# EasyEDA Pro project Cerberus_Sub_Controller_v02.eprj, schematic Cerberus_Sub_Controller_v02, sheet 1 of 3

## Sheets
1 A1: Board Name: Cerberus_Sub_Controller_v02; Create Date: 2024-08-25; Page Name: A1; Project Name: Cerberus_Sub_Controller_v02; Schematic Name: Cerberus_Sub_Controller_v02; Update Date: 2024-08-28
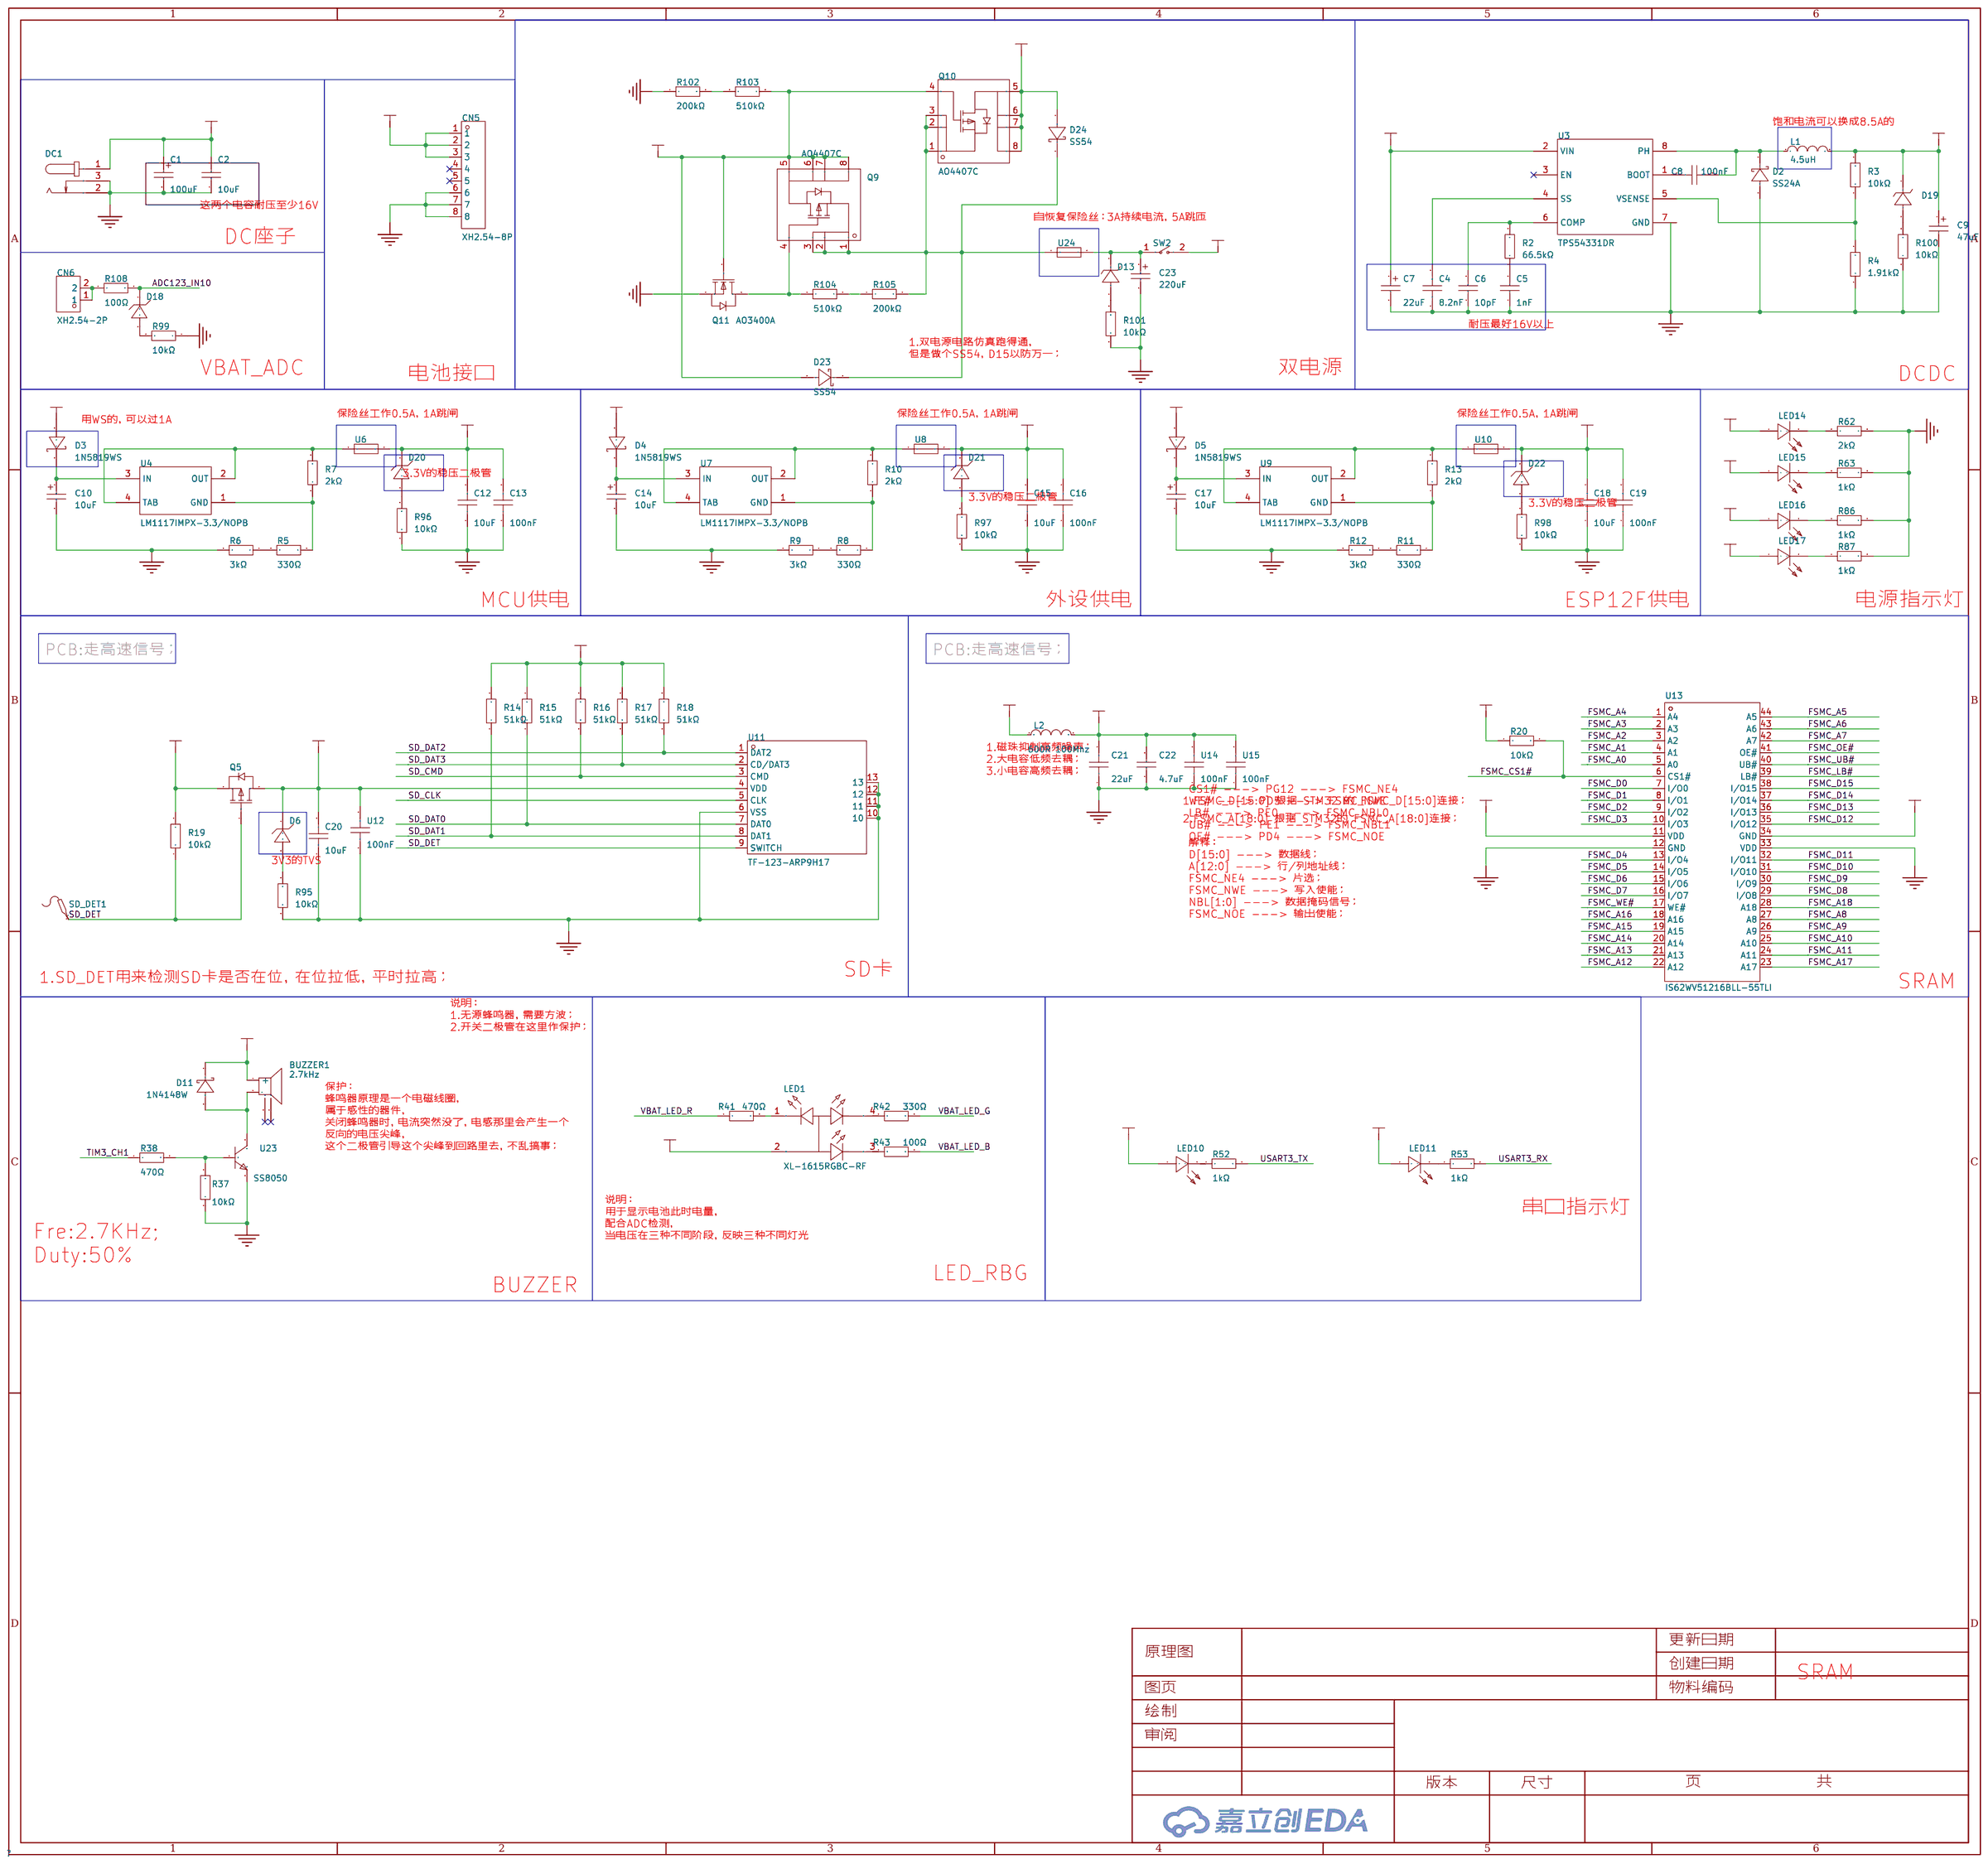
[diagram p0: A1]

## Parts
BUZZER1  2.7kHz  [BUZ-SMD_4P-L8.5-W8.5-P8.50-BR]
C1  100uF  [CAP-SMD_L6.0-W3.2-R-RD]
C2  10uF  [C0603]
C4  8.2nF  [C0603]
C5  1nF  [C0603]
C6  10pF  [C0603]
C7  22uF  [CASE-B_3528]
C8  100nF  [C0603]
C9  47uF  [CAP-SMD_L6.0-W3.2-R-RD]
C10  10uF  [CAP-SMD_L3.2-W1.6-RD-C7171]
C12  10uF  [C0603]
C13  100nF  [C0603]
C14  10uF  [CAP-SMD_L3.2-W1.6-RD-C7171]
C15  10uF  [C0603]
C16  100nF  [C0603]
C17  10uF  [CAP-SMD_L3.2-W1.6-RD-C7171]
C18  10uF  [C0603]
C19  100nF  [C0603]
C20  10uF  [C0603]
C21  22uF  [C0603]
C22  4.7uF  [C0603]
C23  220uF  [CASE-E_7343]
CN5  XH2.54-8P  [CONN-TH_8P-P2.50-XH2.54-8P]
CN6  XH2.54-2P  [CONN-TH_2P-P2.50_HX25003-2A]
D2  SS24A  [SMA_L4.4-W2.6-LS5.1-FD]
D3  1N5819WS  [SOD-323_L1.8-W1.3-LS2.5-RD]
D4  1N5819WS  [SOD-323_L1.8-W1.3-LS2.5-RD]
D5  1N5819WS  [SOD-323_L1.8-W1.3-LS2.5-RD]
D6  MM3Z3V3T1G  [SOD-323_L1.8-W1.3-LS2.5-RD]
D11  1N4148W  [SOD-123_L2.7-W1.6-LS3.7-FD]
D13  BZT52C9V1S  [SOD-323_L1.6-W1.3-LS2.7-RD]
D18  MM3Z3V3T1G  [SOD-323_L1.8-W1.3-LS2.5-RD]
D19  BZT52C5V1S  [SOD-323_L1.7-W1.3-LS2.6-RD]
D20  MM3Z3V3T1G  [SOD-323_L1.8-W1.3-LS2.5-RD]
D21  MM3Z3V3T1G  [SOD-323_L1.8-W1.3-LS2.5-RD]
D22  MM3Z3V3T1G  [SOD-323_L1.8-W1.3-LS2.5-RD]
D23  SS54  [SMA_L4.3-W2.6-LS5.0-FD]
D24  SS54  [SMA_L4.3-W2.6-LS5.0-FD]
DC1  DC005  [DC-IN-TH_DC005]
L1  4.5uH  [IND-SMD_L6.0-W6.0_FNR60XXS]
L2  600R 100Mhz  [L0603]
LED1  XL-1615RGBC-RF  [LED-ARRAY-SMD_4P-L1.6-W1.5-BR_XL-1615RGBC-RF]
LED10  NCD0805R1  [LED0805-R-RD]
LED11  NCD0805R1  [LED0805-R-RD]
LED14  NCD0805R1  [LED0805-R-RD]
LED15  NCD0805R1  [LED0805-R-RD]
LED16  NCD0805R1  [LED0805-R-RD]
LED17  NCD0805R1  [LED0805-R-RD]
Q5  SI2305CDS-T1-GE3  [SOT-23-3_L2.9-W1.3-P1.90-LS2.4-BR]
Q9  AO4407C  [SOP-8_L4.9-W3.9-P1.27-LS6.0-BL]
Q10  AO4407C  [SOP-8_L4.9-W3.9-P1.27-LS6.0-BL]
Q11  AO3400A  [SOT-23-3_L2.9-W1.3-P1.90-LS2.4-BR]
R2  66.5kΩ  [R0603]
R3  10kΩ  [R0603]
R4  1.91kΩ  [R0603]
R5  330Ω  [R0603]
R6  3kΩ  [R0603]
R7  2kΩ  [R0603]
R8  330Ω  [R0603]
R9  3kΩ  [R0603]
R10  2kΩ  [R0603]
R11  330Ω  [R0603]
R12  3kΩ  [R0603]
R13  2kΩ  [R0603]
R14  51kΩ  [R0603]
R15  51kΩ  [R0603]
R16  51kΩ  [R0603]
R17  51kΩ  [R0603]
R18  51kΩ  [R0603]
R19  10kΩ  [R0603]
R20  10kΩ  [R0603]
R37  10kΩ  [R0603]
R38  470Ω  [R0603]
R41  470Ω  [R0603]
R42  330Ω  [R0603]
R43  100Ω  [R0603]
R52  1kΩ  [R0603]
R53  1kΩ  [R0603]
R62  2kΩ  [R0603]
R63  1kΩ  [R0603]
R86  1kΩ  [R0603]
R87  1kΩ  [R0603]
R95  10kΩ  [R0603]
R96  10kΩ  [R0603]
R97  10kΩ  [R0603]
R98  10kΩ  [R0603]
R99  10kΩ  [R0603]
R100  10kΩ  [R0603]
R101  10kΩ  [R0603]
R102  200kΩ  [R0603]
R103  510kΩ  [R0603]
R104  510kΩ  [R0603]
R105  200kΩ  [R0603]
R108  100Ω  [R0603]
SD_DET1  -  [Test-Point-0.5mm]
SW2  KCD11-2P-R  [SW-TH_2P-L15.0-W10.5-P5.00_KCD11-2P-R]
U3  TPS54331DR  [SOIC-8_L5.0-W4.0-P1.27-LS6.0-BL]
U4  LM1117IMPX-3.3/NOPB  [SOT-223_L6.5-W3.5-P2.30-LS7.0-BR]
U6  SMD0805B050TF  [F0805]
U7  LM1117IMPX-3.3/NOPB  [SOT-223_L6.5-W3.5-P2.30-LS7.0-BR]
U8  SMD0805B050TF  [F0805]
U9  LM1117IMPX-3.3/NOPB  [SOT-223_L6.5-W3.5-P2.30-LS7.0-BR]
U10  SMD0805B050TF  [F0805]
U11  TF-123-ARP9H17  [TF-SMD_TF-123-ARP9H15]
U12  100nF  [C0603]
U13  IS62WV51216BLL-55TLI  [TSOP-44_L18.4-W10.2-P0.80-LS11.8-BL]
U14  100nF  [C0603]
U15  100nF  [C0603]
U23  SS8050  [SOT-23-3_L2.9-W1.3-P1.90-LS2.4-BR]
U24  1812L300/16GR  [F1812]

## Library data of the parts
BUZZER1 = MLT-8530_C94599: 驱动方式:无源(外部驱动);构造类型:电磁式;频率:2.7kHz;声压(SPL):80dB@5V,10cm;; LCSC Part Name: MLT-8530; Supplier Part: C94599; Manufacturer: 华能; Manufacturer Part: MLT-8530; Supplier Footprint: SMD,8.5x8.5mm; JLCPCB Part Class: 扩展库; Datasheet: https://atta.szlcsc.com/upload/public/pdf/source/20170522/1495448322339.pdf; Supplier: LCSC; Oscillator Circuit: 无源(外部驱动); Technology Type: 电磁式; Operating Voltage: 2.5V~4.5V; Sound Pressure Level (SPL): 80dB@5V,10cm; Length: 8.5mm; Width: 8.5mm; Height: 3.3mm
C1 = TAJC107K016RNJ: 容值:100uF;精度:±10%;额定电压:16V;等效串联电阻:1Ω@100kHz;; LCSC Part Name: 100uF ±10% 16V; Supplier Part: C11375; Manufacturer: Kyocera AVX; Supplier Footprint: CASE-C-6032; JLCPCB Part Class: 扩展库; Datasheet: https://atta.szlcsc.com/upload/public/pdf/source/20160107/1457707750344.pdf; Supplier: LCSC; Tolerance: ±10%; Rated Voltage: 16V; Equivalent Series Resistance(ESR): 1Ω@100kHz; Operating Temperature: -55℃~+125℃
C2 = CL10A106MO8NQNC: 容值:10uF;精度:±20%;额定电压:16V;材质(温度系数):X5R;; LCSC Part Name: 10uF ±20% 16V; Supplier Part: C92487; Manufacturer: SAMSUNG(三星); Supplier Footprint: 0603; JLCPCB Part Class: 扩展库; Datasheet: https://atta.szlcsc.com/upload/public/pdf/source/20221212/2AEE4C8656EA91AC055807CAAFF57F96.pdf; Supplier: LCSC; Tolerance: ±20%; Voltage Rated: 16V; Temperature Coefficient: X5R
C4 = 0603B822K500NT: 容值:8.2nF;精度:±10%;额定电压:50V;材质(温度系数):X7R;; LCSC Part Name: 8.2nF ±10% 50V; Supplier Part: C1322360; Manufacturer: FH(风华); Supplier Footprint: 0603; JLCPCB Part Class: 基础库; Datasheet: https://atta.szlcsc.com/upload/public/pdf/source/20200305/C486355_26A10D38EF8C2A5C37091D0039909270.pdf; Supplier: LCSC; Tolerance: ±10%; Voltage Rated: 50V; Temperature Coefficient: X7R
C5 = CC0603KRX7R9BB102: 容值:1nF;精度:±10%;额定电压:50V;材质(温度系数):X7R;; LCSC Part Name: 1nF ±10% 50V; Supplier Part: C100040; Manufacturer: YAGEO(国巨); Supplier Footprint: 0603; JLCPCB Part Class: 扩展库; Datasheet: https://atta.szlcsc.com/upload/public/pdf/source/20180910/C282072_33301C7F631E79921B82A8DAC6BCC5B3.pdf; Supplier: LCSC; Tolerance: ±10%; Voltage Rated: 50V; Temperature Coefficient: X7R
C6 = CL10C100JB8NNNC: 容值:10pF;精度:±5%;额定电压:50V;材质(温度系数):C0G;; LCSC Part Name: 10pF ±5% 50V; Supplier Part: C1634; Manufacturer: SAMSUNG(三星); Supplier Footprint: 0603; JLCPCB Part Class: 基础库; Datasheet: https://atta.szlcsc.com/upload/public/pdf/source/20160218/1457707763339.pdf; Supplier: LCSC; Tolerance: ±5%; Voltage Rated: 50V; Temperature Coefficient: C0G
C7 = TAJB226K016RNJ: 容值:22uF;精度:±10%;额定电压:16V;等效串联电阻:2.3Ω@100kHz;; LCSC Part Name: 22uF ±10% 16V; Supplier Part: C8020; Manufacturer: Kyocera AVX; Supplier Footprint: CASE-B-3528; JLCPCB Part Class: 扩展库; Datasheet: https://atta.szlcsc.com/upload/public/pdf/source/20160107/1457707750344.pdf; Supplier: LCSC; Tolerance: ±10%; Rated Voltage: 16V; Equivalent Series Resistance(ESR): 2.3Ω@100kHz; Operating Temperature: -55℃~+125℃
C8 C13 C16 C19 U12 U14 U15 = CGA0603X7R104K500JT: 容值:100nF;精度:±10%;额定电压:50V;材质(温度系数):X7R;; LCSC Part Name: 100nF ±10% 50V; Supplier Part: C6119867; Manufacturer: HRE(芯声); Supplier Footprint: 0603; JLCPCB Part Class: 扩展库; Supplier: LCSC; Tolerance: ±10%; Voltage Rated: 50V; Temperature Coefficient: X7R
C9 = TAJC476K016RNJ: 容值:47uF;精度:±10%;额定电压:16V;等效串联电阻:500mΩ@100kHz;; LCSC Part Name: 47uF ±10% 16V; Supplier Part: C7219; Manufacturer: Kyocera AVX; Supplier Footprint: CASE-C-6032; JLCPCB Part Class: 扩展库; Datasheet: https://atta.szlcsc.com/upload/public/pdf/source/20160107/1457707750344.pdf; Supplier: LCSC; Tolerance: ±10%; Rated Voltage: 16V; Equivalent Series Resistance(ESR): 500mΩ@100kHz; Operating Temperature: -55℃~+125℃
C10 C14 C17 = TAJA106K016RNJ: 容值:10uF;精度:±10%;额定电压:16V;等效串联电阻:3Ω@100kHz;; LCSC Part Name: 10uF ±10% 16V; Supplier Part: C7171; Manufacturer: Kyocera AVX; Supplier Footprint: CASE-A-3216; JLCPCB Part Class: 基础库; Datasheet: https://atta.szlcsc.com/upload/public/pdf/source/20160107/1457707750344.pdf; Supplier: LCSC; Tolerance: ±10%; Rated Voltage: 16V; Equivalent Series Resistance(ESR): 3Ω@100kHz; Operating Temperature: -55℃~+125℃
C12 C15 C18 = CL10A106MP8NNNC: 容值:10uF;精度:±20%;额定电压:10V;材质(温度系数):X5R;; LCSC Part Name: 10uF ±20% 10V; Supplier Part: C85713; Manufacturer: SAMSUNG(三星); Supplier Footprint: 0603; JLCPCB Part Class: 扩展库; Datasheet: https://atta.szlcsc.com/upload/public/pdf/source/20160218/1457707763339.pdf; Supplier: LCSC; Tolerance: ±20%; Voltage Rated: 10V; Temperature Coefficient: X5R
C20 = CL10A106MA8NRNC: 容值:10uF;精度:±20%;额定电压:25V;材质(温度系数):X5R;; LCSC Part Name: 10uF ±20% 25V; Supplier Part: C96446; Manufacturer: SAMSUNG(三星); Supplier Footprint: 0603; JLCPCB Part Class: 基础库; Datasheet: https://atta.szlcsc.com/upload/public/pdf/source/20160218/1457707763339.pdf; Supplier: LCSC; Tolerance: ±20%; Voltage Rated: 25V; Temperature Coefficient: X5R
C21 = CGA0603X5R226M160JT: 容值:22uF;精度:±20%;额定电压:16V;材质(温度系数):X5R;; LCSC Part Name: 22uF ±20% 16V; Supplier Part: C6119868; Manufacturer: HRE(芯声); Supplier Footprint: 0603; JLCPCB Part Class: 扩展库; Supplier: LCSC; Tolerance: ±20%; Voltage Rated: 16V; Temperature Coefficient: X5R
C22 = CL10A475KO8NNNC: 容值:4.7uF;精度:±10%;额定电压:16V;材质(温度系数):X5R;; LCSC Part Name: 4.7uF ±10% 16V; Supplier Part: C19666; Manufacturer: SAMSUNG(三星); Supplier Footprint: 0603; JLCPCB Part Class: 基础库; Datasheet: https://atta.szlcsc.com/upload/public/pdf/source/20160218/1457707763339.pdf; Supplier: LCSC; Tolerance: ±10%; Voltage Rated: 16V; Temperature Coefficient: X5R
C23 = TAJE227K016RNJ: 容值:220uF;精度:±10%;额定电压:16V;等效串联电阻:500mΩ@100kHz;; LCSC Part Name: 220uF ±10% 16V; Supplier Part: C7231; Manufacturer: Kyocera AVX; Supplier Footprint: CASE-E-7343; JLCPCB Part Class: 扩展库; Datasheet: https://atta.szlcsc.com/upload/public/pdf/source/20160107/1457707750344.pdf; Supplier: LCSC; Tolerance: ±10%; Rated Voltage: 16V; Equivalent Series Resistance(ESR): 500mΩ@100kHz; Operating Temperature: -55℃~+125℃
CN5 = ZX-XH2.54-8PZZ: 插针结构:1x8P;间距:2.54mm;安装方式:直插;参考系列:XH;总PIN数:8P;排数:1;每排PIN数:8;行距:-;额定电流:3A;触头材质:黄铜;触头镀层:锡;工作温度范围:-25℃~+85℃;; Supplier Part: C7429638; Manufacturer: Megastar(兆星); Supplier Footprint: 插件,P=2.54mm; JLCPCB Part Class: 扩展库; Datasheet: https://atta.szlcsc.com/upload/public/pdf/source/20230619/688603DEA58996C00B1F33C46797D2C3.pdf; Supplier: LCSC; Pins Structure: 1x8P; Pitch: 2.54mm; Mounting Style: 直插; Reference Series: XH; Number of Pins: 8P; Number of Rows: 1; Number of PINs Per Row: 8; Current Rating (Max): 3A; Contact Material: 黄铜; Contact Plating: 锡; Operating Temperature Range: -25℃~+85℃
CN6 = ZX-XH2.54-2PZZ: 插针结构:1x2P;间距:2.54mm;安装方式:直插;参考系列:XH;总PIN数:2P;排数:1;每排PIN数:2;行距:-;额定电流:3A;触头材质:黄铜;触头镀层:锡;工作温度范围:-25℃~+85℃;; Supplier Part: C7429632; Manufacturer: Megastar(兆星); Supplier Footprint: 插件,P=2.54mm; JLCPCB Part Class: 扩展库; Datasheet: https://atta.szlcsc.com/upload/public/pdf/source/20230619/19BA6947230AA44A04D3EDD65E618FD0.pdf; Supplier: LCSC; Pins Structure: 1x2P; Pitch: 2.54mm; Mounting Style: 直插; Reference Series: XH; Number of Pins: 2P; Number of Rows: 1; Number of PINs Per Row: 2; Current Rating (Max): 3A; Contact Material: 黄铜; Contact Plating: 锡; Operating Temperature Range: -25℃~+85℃
D2 = SS24A: 二极管配置:独立式;正向压降(Vf):500mV@2A;直流反向耐压(Vr):40V;平均整流电流(Io):2A;; LCSC Part Name: 电压:40V 电流:2A; Supplier Part: C2886579; Manufacturer: Hottech(合科泰); Supplier Footprint: SMA(DO-214AC); JLCPCB Part Class: 扩展库; Datasheet: https://atta.szlcsc.com/upload/public/pdf/source/20210827/F72FA65B191CD3E4A90E227FAD6362F0.pdf; Supplier: LCSC; Diode Configuration: 独立式; Forward Voltage (Vf@If): 500mV@2A; Reverse Voltage (Vr): 40V; Average Rectified Current (Io): 2A; Reverse Leakage Current (Ir): 500uA@40V
D3-D5 = 1N5819WS_C191023: 正向压降(Vf):600mV@1A;直流反向耐压(Vr):40V;平均整流电流(Io):1A;; LCSC Part Name: 电压:40V 电流:1A; Supplier Part: C191023; Manufacturer: Hottech(合科泰); Supplier Footprint: SOD-323; JLCPCB Part Class: 基础库; Datasheet: https://atta.szlcsc.com/upload/public/pdf/source/20220428/3CB86FD8D28D653594B4E35F9D5AEFD9.pdf; Supplier: LCSC; Forward Voltage (Vf@If): 600mV@1A; Reverse Voltage (Vr): 40V; Average Rectified Current (Io): 1A
D6 D18 D20-D22 = MM3Z3V3T1G: 二极管配置:独立式;稳压值(标称值):3.3V;稳压值(范围):3.1V~3.5V;功率:300mW;精度:±6%;; Supplier Part: C75073; Manufacturer: onsemi(安森美); Supplier Footprint: SOD-323; JLCPCB Part Class: 扩展库; Datasheet: https://atta.szlcsc.com/upload/public/pdf/source/20190712/C403850_A42691F9D9E3607FEABBF6C43020F3B6.pdf; Supplier: LCSC; Diode Configuration: 独立式; Zener Voltage (Nom): 3.3V; Reverse Leakage Current (Ir): 5uA@1V; Zener Voltage (Range): 3.1V~3.5V; Power Dissipation: 300mW; Zener Impedance (Zzt): 95Ω; Tolerance: ±6%
D11 = 1N4148W_C7420318: 二极管配置:独立式;正向压降(Vf):1.25V@150mA;直流反向耐压(Vr):100V;平均整流电流(Io):150mA;功率:400mW;反向恢复时间(trr):4ns;; LCSC Part Name: 电压:100V 电流:150mA; Supplier Part: C7420318; Manufacturer: 宏迦橙; Supplier Footprint: SOD-123; JLCPCB Part Class: 扩展库; Datasheet: https://atta.szlcsc.com/upload/public/pdf/source/20230828/E5C3F7A4272052930A7E03B75759BF50.pdf; Supplier: LCSC; Diode Configuration: 独立式; Forward Voltage (Vf@If): 1.25V@150mA; Reverse Voltage (Vr): 100V; Average Rectified Current (Io): 150mA; Power Dissipation: 400mW; Reverse Leakage Current: 1uA@75V; Reverse Recovery Time (trr): 4ns; Operating Temperature: -55℃~+150℃
D13 = BZT52C9V1S_C727032: 二极管配置:独立式;稳压值(标称值):9.1V;稳压值(范围):8.5V~9.6V;功率:200mW;精度:-;; Supplier Part: C727032; Manufacturer: TWGMC(台湾迪嘉); Supplier Footprint: SOD-323; JLCPCB Part Class: 扩展库; Datasheet: https://atta.szlcsc.com/upload/public/pdf/source/20200828/C727018_310A971BB988862F9E6EACDF7365A93A.pdf; Supplier: LCSC; Diode Configuration: 独立式; Zener Voltage (Nom): 9.1V; Reverse Leakage Current (Ir): 500nA@6V; Zener Voltage (Range): 8.5V~9.6V; Power Dissipation: 200mW; Zener Impedance (Zzt): 15Ω
D19 = BZT52C5V1S_C2910089: 二极管配置:独立式;稳压值(标称值):5.1V;稳压值(范围):4.8V~5.4V;功率:200mW;精度:-;; Supplier Part: C2910089; Manufacturer: CJ(江苏长电/长晶); Supplier Footprint: SOD-323; JLCPCB Part Class: 扩展库; Datasheet: https://atta.szlcsc.com/upload/public/pdf/source/20211110/D3916CAEFF634E4581A8A1E0064012E0.pdf; Supplier: LCSC; Diode Configuration: 独立式; Zener Voltage (Nom): 5.1V; Reverse Leakage Current (Ir): 2uA@2V; Zener Voltage (Range): 4.8V~5.4V; Power Dissipation: 200mW; Zener Impedance (Zzt): 60Ω
D23 D24 = SS54_C7420369: 二极管配置:独立式;正向压降(Vf):550mV@5.0A;直流反向耐压(Vr):40V;整流电流:5A;; LCSC Part Name: 电压:40V 电流:5A; Supplier Part: C7420369; Manufacturer: 宏迦橙; Supplier Footprint: SMA(DO-214AC); JLCPCB Part Class: 扩展库; Datasheet: https://atta.szlcsc.com/upload/public/pdf/source/20230828/254C3882F8647358AD9F60DD73611B5E.pdf; Supplier: LCSC; Diode Configuration: 独立式; Forward Voltage (Vf@If): 550mV@5.0A; Reverse Voltage (Vr): 40V; Rectified Current: 5A; Reverse Leakage Current (Ir): 50uA@40V
DC1 = DC005: 连接器类型:DC电源插座;安装方式:弯插;触点内径:2mm;触点外径:6.3mm;额定电流:500mA;额定电压:30V;工作温度范围:-40℃~+55℃;; LCSC Part Name: DC电源插座 内径:2mm 外径:6.3mm; Supplier Part: C431533; Manufacturer: SHOU HAN(首韩); Supplier Footprint: 插件; JLCPCB Part Class: 扩展库; Datasheet: https://atta.szlcsc.com/upload/public/pdf/source/20190925/C431533_4751811035784AC1D38EBC85F7905E99.pdf; Supplier: LCSC; Connector Type: DC电源插座; Mounting Style: 弯插; Inside Contact Diameter: 2mm; Outside Contact Diameter: 6.3mm; Current Rating (Max): 500mA; Voltage Rating (Max): 30V; Operating Temperature Range: -40℃~+55℃
L1 = FNR6045S4R5MT: 电感值:4.5uH;精度:±20%;额定电流:3.6A;饱和电流(Isat):5.5A;; LCSC Part Name: 4.5uH ±20% 5.5A; Supplier Part: C168066; Manufacturer: cjiang(长江微电); Supplier Footprint: SMD,6x6mm; JLCPCB Part Class: 扩展库; Datasheet: https://atta.szlcsc.com/upload/public/pdf/source/20190327/C167925_9EFF0AABC4CA629C2CC95961DBF7D39D.pdf; Supplier: LCSC; Tolerance: ±20%; Rated Current: 3.6A; Saturation Current (Isat): 5.5A; DC Resistance (DCR): 34mΩ
L2 = BLM18AG601SN1D: 标称阻抗@测试频率:600Ω@100MHz;误差:±25%;直流电阻(RDC):380mΩ;; LCSC Part Name: 单路 0603磁珠 阻抗600Ω@100MHz; Supplier Part: C19330; Manufacturer: muRata(村田); Supplier Footprint: 0603; JLCPCB Part Class: 扩展库; Datasheet: https://atta.szlcsc.com/upload/public/pdf/source/20180329/C160981_FD3C2D2622A377E203B89F4AA32B0741.pdf; Supplier: LCSC; Impedance @ Frequency: 600Ω@100MHz; Tolerance: ±25%; DC Resistance: 380mΩ; Current Rating: 500mA; Circuits: 1
LED1 = XL-1615RGBC-RF: Supplier Part: C965840; Manufacturer: XINGLIGHT(成兴光); Supplier Footprint: 0606; JLCPCB Part Class: 扩展库; Datasheet: https://atta.szlcsc.com/upload/public/pdf/source/20221102/F1B1FC7E45BA82C0C0D2B0679BEE9200.pdf; Supplier: LCSC
LED10 LED11 LED14-LED17 = NCD0805R1: 灯头类型:-;发光颜色:红色;正向电压(VF):1.6V~2.6V;功率:65mW;正向电流:20mA;主波长:615nm~630nm;二极管配置:独立二极管;透镜颜色:无色透明透镜;色温:-;发光强度:67mcd~195mcd;发光角度:130°;载带方式:-;工作温度:-30℃~+85℃;; Supplier Part: C84256; Manufacturer: 国星光电; Supplier Footprint: 0805; JLCPCB Part Class: 基础库; Datasheet: https://atta.szlcsc.com/upload/public/pdf/source/20200820/C84256_F0A75A43B3EAD75808600A0514C76B99.pdf; Supplier: LCSC; Emitted Color: 红色; Forward Voltage (VF): 1.6V~2.6V; Power Dissipation: 65mW; Forward Current: 20mA; Dominant Wavelength: 615nm~630nm; Diode Configuration: 独立二极管; Lens Color: 无色透明透镜; Luminous Intensity: 67mcd~195mcd; Viewing Angle: 130°; Operating Temperature: -30℃~+85℃
Q5 = SI2305CDS-T1-GE3: 类型:1个P沟道;漏源电压(Vdss):8V;连续漏极电流(Id):5.8A;功率(Pd):960mW；1.7W;导通电阻(RDS(on)@Vgs,Id):35mΩ@4.5V,4.4A;阈值电压(Vgs(th)@Id):1V@250uA;; LCSC Part Name: 1个P沟道 耐压:8V 电流:5.8A; Supplier Part: C37577; Manufacturer: VISHAY(威世); Supplier Footprint: SOT-23; JLCPCB Part Class: 扩展库; Datasheet: https://atta.szlcsc.com/upload/public/pdf/source/20150319/1457707265783.pdf; Supplier: LCSC; Type: 1个P沟道; Drain Source Voltage (Vdss): 8V; Continuous Drain Current (Id): 5.8A; Power Dissipation (Pd): 960mW；1.7W; Drain Source On Resistance (RDS(on)@Vgs,Id): 35mΩ@4.5V,4.4A; Gate Threshold Voltage (Vgs(th)@Id): 1V@250uA; Total Gate Charge (Qg@Vgs): 30nC@8V; Input Capacitance (Ciss@Vds): 960pF@4V; Operating Temperature: -55℃~+150℃@(Tj)
Q9 Q10 = AO4407C: 类型:P沟道;漏源电压(Vdss):30V;连续漏极电流(Id):14A;功率(Pd):3.1W;导通电阻(RDS(on)@Vgs,Id):11.5mΩ@10V,14A;阈值电压(Vgs(th)@Id):2.3V@250uA;; LCSC Part Name: P沟道 耐压:30V 电流:14A 产地：重庆; Supplier Part: C469397; Manufacturer: AOS; Supplier Footprint: SOP-8; JLCPCB Part Class: 扩展库; Datasheet: https://atta.szlcsc.com/upload/public/pdf/source/20191212/C469397_0FA240FA8DBDAEB8A8E95B002A232449.pdf; Supplier: LCSC; Type: P沟道; Drain Source Voltage (Vdss): 30V; Continuous Drain Current (Id): 14A; Power Dissipation (Pd): 3.1W; Drain Source On Resistance (RDS(on)@Vgs,Id): 11.5mΩ@10V,14A; Gate Threshold Voltage (Vgs(th)@Id): 2.3V@250uA
Q11 = AO3400A_C20917: 类型:1个N沟道;漏源电压(Vdss):30V;连续漏极电流(Id):5.7A;功率(Pd):1.4W;导通电阻(RDS(on)@Vgs,Id):26.5mΩ@10V,5.7A;阈值电压(Vgs(th)@Id):1.5V@250uA;; LCSC Part Name: 1个N沟道 耐压:30V 电流:5.7A; Supplier Part: C20917; Manufacturer: AOS; Supplier Footprint: SOT-23-3L; JLCPCB Part Class: 基础库; Datasheet: https://atta.szlcsc.com/upload/public/pdf/source/20140107/1457706668533.pdf; Supplier: LCSC; Type: 1个N沟道; Drain Source Voltage (Vdss): 30V; Continuous Drain Current (Id): 5.7A; Power Dissipation (Pd): 1.4W; Drain Source On Resistance (RDS(on)@Vgs,Id): 26.5mΩ@10V,5.7A; Gate Threshold Voltage (Vgs(th)@Id): 1.5V@250uA; Total Gate Charge (Qg@Vgs): 7nC@4.5V; Input Capacitance (Ciss@Vds): 630pF@15V; Operating Temperature: -55℃~+150℃@(Tj)
R2 = AC0603FR-0766K5L: 电阻类型:厚膜电阻;阻值:66.5kΩ;精度:±1%;功率:100mW;最大工作电压:75V;温度系数:±100ppm/℃;; LCSC Part Name: 厚膜电阻 66.5kΩ ±1% 100mW; Supplier Part: C228011; Manufacturer: YAGEO(国巨); Supplier Footprint: 0603; JLCPCB Part Class: 扩展库; Datasheet: https://atta.szlcsc.com/upload/public/pdf/source/20181114/C228011_7584077358498BE0F1FFAE03DACCF6D8.pdf; Supplier: LCSC; Type: 厚膜电阻; Tolerance: ±1%; Power(Watts): 100mW; Overload Voltage (Max): 75V; Temperature Coefficient: ±100ppm/℃; Operating Temperature Range: -55℃~+155℃
R3 R19 R20 R37 R95-R101 = 0603WAF1002T5E: 电阻类型:厚膜电阻;阻值:10kΩ;精度:±1%;功率:100mW;最大工作电压:75V;温度系数:±100ppm/℃;; LCSC Part Name: 厚膜电阻 10kΩ ±1% 100mW; Supplier Part: C25804; Manufacturer: UNI-ROYAL(厚声); Supplier Footprint: 0603; JLCPCB Part Class: 基础库; Datasheet: https://atta.szlcsc.com/upload/public/pdf/source/20200306/C422600_1E6D84923E4A46A82E41ADD87F860B5C.pdf; Supplier: LCSC; Type: 厚膜电阻; Tolerance: ±1%; Power(Watts): 100mW; Overload Voltage (Max): 75V; Temperature Coefficient: ±100ppm/℃; Operating Temperature Range: -55℃~+155℃
R4 = 0603WAF1911T5E: 电阻类型:厚膜电阻;阻值:1.91kΩ;精度:±1%;功率:100mW;最大工作电压:75V;温度系数:±100ppm/℃;; LCSC Part Name: 1.91kΩ ±1% 100mW 厚膜电阻; Supplier Part: C22853; Manufacturer: UNI-ROYAL(厚声); Supplier Footprint: 0603; JLCPCB Part Class: 扩展库; Datasheet: https://atta.szlcsc.com/upload/public/pdf/source/20200306/C422600_1E6D84923E4A46A82E41ADD87F860B5C.pdf; Supplier: LCSC; Type: 厚膜电阻; Tolerance: ±1%; Power(Watts): 100mW; Overload Voltage (Max): 75V; Temperature Coefficient: ±100ppm/℃; Operating Temperature Range: -55℃~+155℃
R5 R8 R11 R42 = 0603WAF3300T5E: 电阻类型:厚膜电阻;阻值:330Ω;精度:±1%;功率:100mW;最大工作电压:75V;温度系数:±100ppm/℃;; LCSC Part Name: 330Ω ±1% 100mW 厚膜电阻; Supplier Part: C23138; Manufacturer: UNI-ROYAL(厚声); Supplier Footprint: 0603; JLCPCB Part Class: 基础库; Datasheet: https://atta.szlcsc.com/upload/public/pdf/source/20200306/C422600_1E6D84923E4A46A82E41ADD87F860B5C.pdf; Supplier: LCSC; Type: 厚膜电阻; Tolerance: ±1%; Power(Watts): 100mW; Overload Voltage (Max): 75V; Temperature Coefficient: ±100ppm/℃; Operating Temperature Range: -55℃~+155℃
R6 R9 R12 = 0603WAF3001T5E: 电阻类型:厚膜电阻;阻值:3kΩ;精度:±1%;功率:100mW;最大工作电压:75V;温度系数:±100ppm/℃;; LCSC Part Name: 3kΩ ±1% 100mW 厚膜电阻; Supplier Part: C4211; Manufacturer: UNI-ROYAL(厚声); Supplier Footprint: 0603; JLCPCB Part Class: 基础库; Datasheet: https://atta.szlcsc.com/upload/public/pdf/source/20200306/C422600_1E6D84923E4A46A82E41ADD87F860B5C.pdf; Supplier: LCSC; Type: 厚膜电阻; Tolerance: ±1%; Power(Watts): 100mW; Overload Voltage (Max): 75V; Temperature Coefficient: ±100ppm/℃; Operating Temperature Range: -55℃~+155℃
R7 R10 R13 R62 = 0603WAF2001T5E: 电阻类型:厚膜电阻;阻值:2kΩ;精度:±1%;功率:100mW;最大工作电压:75V;温度系数:±100ppm/℃;; LCSC Part Name: 2kΩ ±1% 100mW 厚膜电阻; Supplier Part: C22975; Manufacturer: UNI-ROYAL(厚声); Supplier Footprint: 0603; JLCPCB Part Class: 基础库; Datasheet: https://atta.szlcsc.com/upload/public/pdf/source/20200306/C422600_1E6D84923E4A46A82E41ADD87F860B5C.pdf; Supplier: LCSC; Type: 厚膜电阻; Tolerance: ±1%; Power(Watts): 100mW; Overload Voltage (Max): 75V; Temperature Coefficient: ±100ppm/℃; Operating Temperature Range: -55℃~+155℃
R14-R18 = 0603WAF5102T5E: 电阻类型:厚膜电阻;阻值:51kΩ;精度:±1%;功率:100mW;最大工作电压:75V;温度系数:±100ppm/℃;; LCSC Part Name: 51kΩ ±1% 100mW 厚膜电阻; Supplier Part: C23196; Manufacturer: UNI-ROYAL(厚声); Supplier Footprint: 0603; JLCPCB Part Class: 基础库; Datasheet: https://atta.szlcsc.com/upload/public/pdf/source/20200306/C422600_1E6D84923E4A46A82E41ADD87F860B5C.pdf; Supplier: LCSC; Type: 厚膜电阻; Tolerance: ±1%; Power(Watts): 100mW; Overload Voltage (Max): 75V; Temperature Coefficient: ±100ppm/℃; Operating Temperature Range: -55℃~+155℃
R38 R41 = 0603WAF4700T5E: 电阻类型:厚膜电阻;阻值:470Ω;精度:±1%;功率:100mW;最大工作电压:75V;温度系数:±100ppm/℃;; LCSC Part Name: 470Ω ±1% 100mW 厚膜电阻; Supplier Part: C23179; Manufacturer: UNI-ROYAL(厚声); Supplier Footprint: 0603; JLCPCB Part Class: 基础库; Datasheet: https://atta.szlcsc.com/upload/public/pdf/source/20200306/C422600_1E6D84923E4A46A82E41ADD87F860B5C.pdf; Supplier: LCSC; Type: 厚膜电阻; Tolerance: ±1%; Power(Watts): 100mW; Overload Voltage (Max): 75V; Temperature Coefficient: ±100ppm/℃; Operating Temperature Range: -55℃~+155℃
R43 = RC0603FR-07100RL: 电阻类型:厚膜电阻;阻值:100Ω;精度:±1%;功率:100mW;最大工作电压:75V;温度系数:±100ppm/℃;; LCSC Part Name: 厚膜电阻 100Ω ±1% 100mW; Supplier Part: C105588; Manufacturer: YAGEO(国巨); Supplier Footprint: 0603; JLCPCB Part Class: 扩展库; Datasheet: https://atta.szlcsc.com/upload/public/pdf/source/20180316/70C0E2BDAE7FCC62C531A5A58D202EE1.pdf; Supplier: LCSC; Type: 厚膜电阻; Tolerance: ±1%; Power(Watts): 100mW; Overload Voltage (Max): 75V; Temperature Coefficient: ±100ppm/℃; Operating Temperature Range: -55℃~+155℃
R52 R53 = RC0603FR-071KL: 电阻类型:厚膜电阻;阻值:1kΩ;精度:±1%;功率:100mW;最大工作电压:75V;温度系数:±100ppm/℃;; LCSC Part Name: 厚膜电阻 1kΩ ±1% 100mW; Supplier Part: C22548; Manufacturer: YAGEO(国巨); Supplier Footprint: 0603; JLCPCB Part Class: 扩展库; Datasheet: https://atta.szlcsc.com/upload/public/pdf/source/20180316/70C0E2BDAE7FCC62C531A5A58D202EE1.pdf; Supplier: LCSC; Type: 厚膜电阻; Tolerance: ±1%; Power(Watts): 100mW; Overload Voltage (Max): 75V; Temperature Coefficient: ±100ppm/℃; Operating Temperature Range: -55℃~+155℃
R63 R86 R87 = 0603WAF1001T5E: 电阻类型:厚膜电阻;阻值:1kΩ;精度:±1%;功率:100mW;最大工作电压:75V;温度系数:±100ppm/℃;; LCSC Part Name: 1kΩ ±1% 100mW 厚膜电阻; Supplier Part: C21190; Manufacturer: UNI-ROYAL(厚声); Supplier Footprint: 0603; JLCPCB Part Class: 基础库; Datasheet: https://atta.szlcsc.com/upload/public/pdf/source/20200306/C422600_1E6D84923E4A46A82E41ADD87F860B5C.pdf; Supplier: LCSC; Type: 厚膜电阻; Tolerance: ±1%; Power(Watts): 100mW; Overload Voltage (Max): 75V; Temperature Coefficient: ±100ppm/℃; Operating Temperature Range: -55℃~+155℃
R102 R105 = 0603WAF2003T5E: 电阻类型:厚膜电阻;阻值:200kΩ;精度:±1%;功率:100mW;最大工作电压:75V;温度系数:±100ppm/℃;; LCSC Part Name: 200kΩ ±1% 100mW 厚膜电阻; Supplier Part: C25811; Manufacturer: UNI-ROYAL(厚声); Supplier Footprint: 0603; JLCPCB Part Class: 基础库; Datasheet: https://atta.szlcsc.com/upload/public/pdf/source/20200306/C422600_1E6D84923E4A46A82E41ADD87F860B5C.pdf; Supplier: LCSC; Type: 厚膜电阻; Tolerance: ±1%; Power(Watts): 100mW; Overload Voltage (Max): 75V; Temperature Coefficient: ±100ppm/℃; Operating Temperature Range: -55℃~+155℃
R103 R104 = 0603WAF5103T5E: 电阻类型:厚膜电阻;阻值:510kΩ;精度:±1%;功率:100mW;最大工作电压:75V;温度系数:±100ppm/℃;; LCSC Part Name: 510kΩ ±1% 100mW 厚膜电阻; Supplier Part: C23192; Manufacturer: UNI-ROYAL(厚声); Supplier Footprint: 0603; JLCPCB Part Class: 基础库; Datasheet: https://atta.szlcsc.com/upload/public/pdf/source/20200306/C422600_1E6D84923E4A46A82E41ADD87F860B5C.pdf; Supplier: LCSC; Type: 厚膜电阻; Tolerance: ±1%; Power(Watts): 100mW; Overload Voltage (Max): 75V; Temperature Coefficient: ±100ppm/℃; Operating Temperature Range: -55℃~+155℃
R108 = 0603WAF1000T5E: 电阻类型:厚膜电阻;阻值:100Ω;精度:±1%;功率:100mW;最大工作电压:75V;温度系数:±200ppm/℃;; LCSC Part Name: 100Ω ±1% 100mW 厚膜电阻; Supplier Part: C22775; Manufacturer: UNI-ROYAL(厚声); Supplier Footprint: 0603; JLCPCB Part Class: 基础库; Datasheet: https://atta.szlcsc.com/upload/public/pdf/source/20200306/C422600_1E6D84923E4A46A82E41ADD87F860B5C.pdf; Supplier: LCSC; Type: 厚膜电阻; Tolerance: ±1%; Power(Watts): 100mW; Overload Voltage (Max): 75V; Temperature Coefficient: ±200ppm/℃; Operating Temperature Range: -55℃~+155℃
SD_DET1 = Test-Point: Test Point 测试点
SW2 = KCD11-2P-R: 带灯:无;引脚样式:焊片;额定电流:3A;额定电压(AC):250V;额定电压(DC):-;电路结构:单刀单掷;机械寿命:1万次;; LCSC Part Name: 10.5*15mm 两脚两档跷板开关 红钮; Supplier Part: C5884414; Manufacturer: SHOU HAN(首韩); Supplier Footprint: 插件; JLCPCB Part Class: 扩展库; Datasheet: https://atta.szlcsc.com/upload/public/pdf/source/20230506/CD06DFDE35C8048D34175BFF4AF6A2C2.pdf; Supplier: LCSC; Switch Length: 15mm; Switch Width: 10.5mm; Switch Height: 17.2mm; Actuator Type: 凹面弯曲; With Lamp: 无; Pin Style: 焊片; Actuator Color: 红色; Contact Current: 3A; Voltage Rating (AC): 250V; Circuit: 单刀单掷; Mechanical Life: 1万次; Operating Temperature: 0℃~+125℃; Actuator Identifier: - O
U3 = TPS54331DR: 功能类型:降压型;输出类型:可调;输入电压:3.5V~28V;输出电压:800mV~25V;输出电流:3A;; LCSC Part Name: 具有 Eco-mode 的 3.5V 至 28V 输入、3A、570kHz 降压转换器; Supplier Part: C9865; Manufacturer: TI(德州仪器); Supplier Footprint: SOIC-8; JLCPCB Part Class: 扩展库; Datasheet: https://www.ti.com/cn/lit/gpn/tps54331; Supplier: LCSC; Function: 降压型; Output Type: 可调; Input Voltage: 3.5V~28V; Output Voltage: 800mV~25V; Output Current: 3A; Operating Temperature: -40℃~+150℃@(TJ); Synchronous Rectification: 否; Number of Outputs: 1; Topology: 降压式; Switch tube (built-in/external): 内置
U4 U7 U9 = LM1117IMPX-3.3/NOPB: 输出类型:固定;最大输入电压:15V;输出电压:3.3V;最大输出电流:800mA;电源纹波抑制比(PSRR):75dB@(120Hz);输出极性:正极;; LCSC Part Name: 输入20V 输出3.3V 800mA; Supplier Part: C23984; Manufacturer: TI(德州仪器); Supplier Footprint: SOT-223; JLCPCB Part Class: 扩展库; Datasheet: http://www.ti.com/cn/lit/gpn/lm1117; Supplier: LCSC; Output Type: 固定; Maximum Input Voltage: 15V; Output Voltage: 3.3V; MAX Output Current: 800mA; Power Supply Rejection Ratio (PSRR): 75dB@(120Hz); Dropout Voltage: 1.2V@(800mA); standby current: 5mA; Operating Temperature: -40℃~+125℃; Output Polarity: 正极; Number of Outputs: 1
U6 U8 U10 = SMD0805B050TF: 最大电压:6V;最大电流:100A;保持电流:500mA;跳闸电流:1A;; LCSC Part Name: 6V 500mA 0805自恢复; Supplier Part: C269104; Manufacturer: Brightking(君耀电子); Supplier Footprint: 0805; JLCPCB Part Class: 扩展库; Datasheet: https://atta.szlcsc.com/upload/public/pdf/source/20180913/C269107_1BF28CF6F4C5BFD5B8CD673BC8D2B923.pdf; Supplier: LCSC; Operating Voltage (Max): 6V; Current Rating (Max): 100A; Hold Current: 500mA; Trip Current: 1A; Resistance - Initial (Ri) (Min): 150mΩ; Maximum Time to Trip: 100ms; Operating Temperature: -40℃~+85℃；-40℃~+85℃；-40℃~+85℃
U11 = TF-123-ARP9H17: 卡连接方式:拔插式;卡类型:MicroSD卡(TF卡);连接器类型:卡座;本体最大高度:1.7mm;触头材质:磷铜;触头镀层:金;工作温度范围:-25℃~+85℃;焊接温度(最大值):260℃;; LCSC Part Name: 拔插式 MicroSD卡(TF卡) 卡座; Supplier Part: C2982548; Manufacturer: XUNPU(讯普); Supplier Footprint: SMD; JLCPCB Part Class: 扩展库; Datasheet: https://atta.szlcsc.com/upload/public/pdf/source/20220311/12D4DAC699E408EFF19FAC6014C660FF.pdf; Supplier: LCSC; Card Connection Mode: 拔插式; Card Type: MicroSD卡(TF卡); Connector Type: 卡座; Maximum Body Height: 1.7mm; Contact Material: 磷铜; Contact Plating: 金; Operating Temperature Range: -25℃~+85℃; Soldering Temperature(Max): 260℃
U13 = IS62WV51216BLL-55TLI: 8-Mbit(512K × 16bit)，并行接口，工作电压：2.5V to 3.6V; Supplier Part: C11315; Manufacturer: ISSI(美国芯成); Supplier Footprint: TSOP-44-10.2mm; JLCPCB Part Class: 扩展库; Datasheet: https://atta.szlcsc.com/upload/public/pdf/source/20130225/1457706593006.pdf; Supplier: LCSC
U23 = SS8050_C7420370: 晶体管类型:NPN;集电极电流(Ic):1.5A;集射极击穿电压(Vceo):25V;功率(Pd):300mW;直流电流增益(hFE@Ic,Vce):120@100mA,1.0V;; LCSC Part Name: 耐压:25V 电流:1.5A NPN H档 200-350; Supplier Part: C7420370; Manufacturer: 宏迦橙; Supplier Footprint: SOT-23; JLCPCB Part Class: 扩展库; Datasheet: https://atta.szlcsc.com/upload/public/pdf/source/20231222/9C4050A7669EB24B3ACD0418218817FD.pdf; Supplier: LCSC; Transistor Type: NPN; Collector Current (Ic): 1.5A; Collector-Emitter Breakdown Voltage (Vceo): 25V; Power Dissipation (Pd): 300mW; DC Current Gain (hFE@Ic,Vce): 120@100mA,1.0V; Transition Frequency (fT): 100MHz; Collector Cut-Off Current (Icbo): 100nA; Collector-Emitter Saturation Voltage (VCE(sat)@Ic,Ib): 500mV@800mA,80mA; Operating Temperature: -55℃~+150℃
U24 = 1812L300/16GR: 最大电压:16V;最大电流:40A;保持电流:3A;跳闸电流:5A;; LCSC Part Name: 16V 3A 自恢复保险丝; Supplier Part: C18198349; Manufacturer: LUTE(陆特); Supplier Footprint: 1812; JLCPCB Part Class: Extended Part; Datasheet: https://atta.szlcsc.com/upload/public/pdf/source/20230926/57461D6230B1C3E982BE957E074F147E.pdf; Supplier: LCSC; Operating Voltage (Max): 16V; Current Rating (Max): 40A; Hold Current: 3A; Trip Current: 5A; Power Dissipation: 1.4W; Resistance - Initial (Ri) (Min): 10mΩ; Resistance - Post Trip (R1) (Max): 50mΩ; Maximum Time to Trip: 4s; Operating Temperature: -40℃~+85℃

## Nets
GND: C1.2 C2.1 C4.1 C5.1 C6.1 C7.2 C9.2 C10.2 C12.1 C13.1 C14.2 C15.1 C16.1 C17.2 C18.1 C19.1 C20.1 C21.1 C22.1 C23.2 CN5.6 CN5.7 CN5.8 D2.1(A) DC1.2 DC1.3 Q11.2(S) R4.1 R6.2 R9.2 R12.2 R37.1 R62.2 R63.2 R86.2 R87.2 R95.1 R96.1 R97.1 R98.1 R99.1 R100.1 R101.1 R102.1 U3.7(GND) U11.6(VSS) U11.10 U11.11 U11.12 U11.13 U12.1 U13.12(GND) U13.33(VDD) U14.1 U15.1 U23.2(E) ; also on sheet 2 3
VBAT_LED_B: R43.2 ; also on sheet 3
VBAT_LED_G: R42.2 ; also on sheet 3
VBAT_LED_R: R41.1 ; also on sheet 3
VCC_5V: C9.1 D3.2(A) D4.2(A) D5.2(A) D19.1(K) L1.2 LED15.1(+) R3.2 ; also on sheet 2
VCC_7V4: C7.1 LED14.1(+) SW2.2 U3.2(VIN)
VCC_BAT_7V4: CN5.1 CN5.2 CN5.3 D24.1(A) Q10.5(D) Q10.6(D) Q10.7(D) Q10.8(D)
VCC_DC_7V4: C1.1 C2.2 D23.1(A) DC1.1 Q9.5(D) Q9.6(D) Q9.7(D) Q9.8(D) Q10.4(G) Q11.1(G) R103.2
VCC_ESP_3V3: C18.2 C19.2 D22.1(K) U10.2 ; also on sheet 2
VCC_FSMC_3V3: C21.2 C22.2 L2.2 R20.1 U13.11(VDD) U13.34(GND) U14.2 U15.2
VCC_MCU_3V3: C12.2 C13.2 D20.1(K) LED17.1(+) U6.2 ; also on sheet 3
VCC_PER_3V3: BUZZER1.1(+) C15.2 C16.2 D11.2(K) D21.1(K) L2.1 LED1.2(COM+) LED10.1(+) LED11.1(+) LED16.1(+) Q5.2(S) R14.2 R15.2 R16.2 R17.2 R18.2 R19.2 U8.2 ; also on sheet 2 3
VCC_SD_3V3: C20.2 D6.1(K) Q5.3(D) U11.4(VDD) U12.2
ADC123_IN10: D18.1(K) R108.2 ; also on sheet 3
FSMC_A0: U13.5(A0) ; also on sheet 3
FSMC_A1: U13.4(A1) ; also on sheet 3
FSMC_A2: U13.3(A2) ; also on sheet 3
FSMC_A3: U13.2(A3) ; also on sheet 3
FSMC_A4: U13.1(A4) ; also on sheet 3
FSMC_A5: U13.44(A5) ; also on sheet 3
FSMC_A6: U13.43(A6) ; also on sheet 3
FSMC_A7: U13.42(A7) ; also on sheet 3
FSMC_A8: U13.27(A8) ; also on sheet 3
FSMC_A9: U13.26(A9) ; also on sheet 3
FSMC_A10: U13.25(A10) ; also on sheet 3
FSMC_A11: U13.24(A11) ; also on sheet 3
FSMC_A12: U13.22(A12) ; also on sheet 3
FSMC_A13: U13.21(A13) ; also on sheet 3
FSMC_A14: U13.20(A14) ; also on sheet 3
FSMC_A15: U13.19(A15) ; also on sheet 3
FSMC_A16: U13.18(A16) ; also on sheet 3
FSMC_A17: U13.23(A17) ; also on sheet 3
FSMC_A18: U13.28(A18) ; also on sheet 3
FSMC_CS1#: R20.2 U13.6(CS1#) ; also on sheet 3
FSMC_D0: U13.7(I/O0) ; also on sheet 3
FSMC_D1: U13.8(I/O1) ; also on sheet 3
FSMC_D2: U13.9(I/O2) ; also on sheet 3
FSMC_D3: U13.10(I/O3) ; also on sheet 3
FSMC_D4: U13.13(I/O4) ; also on sheet 3
FSMC_D5: U13.14(I/O5) ; also on sheet 3
FSMC_D6: U13.15(I/O6) ; also on sheet 3
FSMC_D7: U13.16(I/O7) ; also on sheet 3
FSMC_D8: U13.29(I/O8) ; also on sheet 3
FSMC_D9: U13.30(I/O9) ; also on sheet 3
FSMC_D10: U13.31(I/O10) ; also on sheet 3
FSMC_D11: U13.32(I/O11) ; also on sheet 3
FSMC_D12: U13.35(I/O12) ; also on sheet 3
FSMC_D13: U13.36(I/O13) ; also on sheet 3
FSMC_D14: U13.37(I/O14) ; also on sheet 3
FSMC_D15: U13.38(I/O15) ; also on sheet 3
FSMC_LB#: U13.39(LB#) ; also on sheet 3
FSMC_OE#: U13.41(OE#) ; also on sheet 3
FSMC_UB#: U13.40(UB#) ; also on sheet 3
FSMC_WE#: U13.17(WE#) ; also on sheet 3
SD_CLK: U11.5(CLK) ; also on sheet 3
SD_CMD: R16.1 U11.3(CMD) ; also on sheet 3
SD_DAT0: R15.1 U11.7(DAT0) ; also on sheet 3
SD_DAT1: R14.1 U11.8(DAT1) ; also on sheet 3
SD_DAT2: R18.1 U11.1(DAT2) ; also on sheet 3
SD_DAT3: R17.1 U11.2(CD/DAT3) ; also on sheet 3
SD_DET: Q5.1(G) R19.1 SD_DET1.1 U11.9(SWITCH)
TIM3_CH1: R38.1 ; also on sheet 3
USART3_RX: R53.2 ; also on sheet 2 3
USART3_TX: R52.2 ; also on sheet 2 3
$1N1726: C4.2 U3.4(SS)
$1N1843: C5.2 R2.1
$1N1949: C6.2 R2.2 U3.6(COMP)
$1N2122: C8.1 U3.1(BOOT)
$1N2501: R3.1 R4.2 U3.5(VSENSE)
$1N2585: C8.2 D2.2(K) L1.1 U3.8(PH)
$1N3113: R5.2 R6.1
$1N3446: R7.2 U4.2(OUT) U4.4(TAB) U6.1
$1N4301: R8.2 R9.1
$1N4315: R10.2 U7.2(OUT) U7.4(TAB) U8.1
$1N4707: R11.2 R12.1
$1N4721: R13.2 U9.2(OUT) U9.4(TAB) U10.1
$1N4748: R11.1 R13.1 U9.1(GND)
$1N4784: R8.1 R10.1 U7.1(GND)
$1N4807: R5.1 R7.1 U4.1(GND)
$1N4899: C10.1 D3.1(K) U4.3(IN)
$1N4974: C14.1 D4.1(K) U7.3(IN)
$1N5020: C17.1 D5.1(K) U9.3(IN)
$1N9181: R37.2 R38.2 U23.1(B)
$1N11173: C23.1 D13.1(K) SW2.1 U24.2
$1N13155: D6.2(A) R95.2
$1N13401: D21.2(A) R97.2
$1N13531: D18.2(A) R99.2
$1N13687: D19.2(A) R100.2
$1N13763: D20.2(A) R96.2
$1N13849: D22.2(A) R98.2
$1N13895: D13.2(A) R101.2
$1N18758: R102.2 R103.1
$1N19044: R104.2 R105.1
$1N19049: Q9.4(G) Q11.3(D) R104.1
$1N19262: D23.2(K) D24.2(K) Q9.1(S) Q9.2(S) Q9.3(S) Q10.1(S) Q10.2(S) Q10.3(S) R105.2 U24.1
$1N26422: CN6.1 CN6.2 R108.1
Net-(BUZZER1-2): BUZZER1.2 D11.1(A) U23.3(C)
Net-(LED1-1): LED1.1(R-) R41.2
Net-(LED1-3): LED1.3(B-) R43.1
Net-(LED1-4): LED1.4(G-) R42.1
Net-(LED10-2): LED10.2(-) R52.1
Net-(LED11-2): LED11.2(-) R53.1
Net-(LED14-2): LED14.2(-) R62.1
Net-(LED15-2): LED15.2(-) R63.1
Net-(LED16-2): LED16.2(-) R86.1
Net-(LED17-2): LED17.2(-) R87.1

Not connected (* = marked no-connect by the designer): BUZZER1 3* 4*; CN5 4* 5*; U3 3(EN)*

## Notes on the sheets
sheet 1
- 饱和电流可以换成8.5A的
- 这两个电容耐压至少16V
- 自恢复保险丝：3A持续电流，5A跳匝
- DC座子
- 耐压最好16V以上
- 1.双电源电路仿真跑得通，
  但是做个SS54，D15以防万一；
- VBAT_ADC
- 双电源
- 电池接口
- DCDC
- 保险丝工作0.5A，1A跳闸
- 保险丝工作0.5A，1A跳闸
- 保险丝工作0.5A，1A跳闸
- 用WS的，可以过1A
- 3.3V的稳压二极管
- 3.3V的稳压二极管
- 3.3V的稳压二极管
- MCU供电
- 外设供电
- ESP12F供电
- 电源指示灯
- PCB:走高速信号；
- PCB:走高速信号；
- 1.磁珠抑制高频噪声；
  2.大电容低频去耦；
  3.小电容高频去耦；
- 1.FSMC_D[15:0] 根据 STM32 的 FSMC_D[15:0]连接；
- 2.FSMC_A[18:0] 根据 STM32的 FSMC_A[18:0]连接；
- CS1# ---> PG12 ---> FSMC_NE4
  WE# ---> PD5 ---> FSMC_NWE
  LB# ---> PE0 ---> FSMC_NBL0
  UB# ---> PE1 ---> FSMC_NBL1
  OE# ---> PD4 ---> FSMC_NOE
- 3V3的TVS
- 解释：
  D[15:0] ---> 数据线；
  A[12:0] ---> 行/列地址线；
  FSMC_NE4 ---> 片选；
  FSMC_NWE ---> 写入使能；
  NBL[1:0] ---> 数据掩码信号；
  FSMC_NOE ---> 输出使能；
- 1.SD_DET用来检测SD卡是否在位，在位拉低，平时拉高；
- SD卡
- SRAM
- 说明：
  1.无源蜂鸣器，需要方波；
  2.开关二极管在这里作保护；
- 保护：
  蜂鸣器原理是一个电磁线圈，
  属于感性的器件，
  关闭蜂鸣器时，电流突然没了，电感那里会产生一个
  反向的电压尖峰，
  这个二极管引导这个尖峰到回路里去，不乱搞事；
- 串口指示灯
- 说明：
  用于显示电池此时电量，
  配合ADC检测，
  当电压在三种不同阶段，反映三种不同灯光
- Fre:2.7KHz;
  Duty:50%
- BUZZER
- LED_RBG
- SRAM
